# EAGLE board Mk4 Final a (EAGLE 9.0.1), part 3 of 3
## Tracks (layer width: path | path; a pad name or v marks a point on that pad's centre or on a via) (continued)
SDRAM_DQMH  (via drill 0.3) (continued)
  Top 0.15: v33.55,51.75 arc45 33.8,52.35 33.8,59.59 arc-45 34.09,60.29 35.53,61.73 arc-45 36.24,62.02 44.66,62.02 44.77,62.14 arc-90 45.83,62.14 46.09,61.88 55.74,61.88 arc-45 56.09,61.73 56.23,61.59 arc45 56.58,61.45 57.94,61.45 arc-45 58.65,61.15 59.26,60.54 arc-45 59.55,59.84 v59.55,58
  Bottom 0.15: IC2.39 30.99,51.1 arc45 31.69,51.39 31.76,51.46 arc-45 32.46,51.75 v33.55,51.75 | IC1.82 60.4,59.26 arc-45 60.11,58.56 v59.55,58
SDRAM_DQML  (via drill 0.3)
  Top 0.15: v41.05,51.75 41.3,51.75 arc90 42.3,52.75 42.3,56.7 arc90 41.3,57.7 arc-45 40.79,57.91 40.72,57.98 arc-45 40.5,58.51 40.5,59.59 arc-45 40.72,60.12 arc-45 41.34,60.38 arc45 41.64,60.5 41.85,60.71 arc-45 42.55,61 44.63,61 44.77,60.86 arc90 45.83,60.86 45.94,60.98 55.37,60.98 arc-45 55.72,60.83 56.76,59.79 arc-45 57.05,59.09 57.05,59 arc90 58.05,58 v58.8,58
  Bottom 0.15: IC2.15 41.41,51.9 arc45 v41.05,51.75 | IC1.81 60,59.61 arc-45 59.71,58.91 v58.8,58
SIM_CLK  (via drill 0.3)
  Top 0.2: v99.8,39 99.8,38.91 arc45 100.09,38.21 103.01,35.29 arc45 103.71,35 104.64,35 arc-45 105.34,34.71 107.16,32.89 arc45 107.86,32.6 108.7,32.6 108.75,32.55 109.35,32.55 arc-90 109.85,32.05 109.85,31.8 arc-45 109.79,31.66 109.76,31.62 arc45 109.7,31.48 109.7,31.16 arc45 109.85,30.8 v110.45,30.2 | v99.3,55.15 99.3,55.12 99.55,54.87 arc-45 99.7,54.52 99.7,53.2 arc-45 99.59,52.94 arc45 99.3,52.24 v99.3,48
  3V3@2 0.2: v110.45,30.2 110.55,30.1 111.8,30.1 112.55,29.35 112.55,25.7 v114.73,23.52
  Bottom 0.2: J1.C3 v114.73,23.52 | v99.3,48 arc45 99.05,47.4 99.05,41.34 arc-45 98.83,40.81 98.47,40.45 arc45 98.25,39.92 98.25,39.48 arc45 98.4,39.13 98.7,38.83 arc90 99.4,38.83 99.58,39 v99.8,39 | R27.2 99.3,53.72 99.35,53.77 99.35,54.23 99.3,54.28 v99.3,55.15 | IC10.2 110.25,30.4 v110.45,30.2
SIM_CLK_R
  Bottom 0.2: IC5.16 99.2,51.9 R27.1 C49.2
SIM_CTS
  Bottom 0.2: R34.1 86.3,38.25 TP4.TP
SIM_CTS_R
  Bottom 0.15: IC5.4 R34.2
SIM_D_N
  Bottom 0.25: IC5.26 109.15,42.65 109.5,43 109.9,43 arc90 111.6,44.7 111.6,49.37 arc-90 JP9.2
SIM_D_P
  Bottom 0.25: IC5.25 109.15,43.75 109.5,43.4 109.9,43.4 arc90 111.2,44.7 111.2,49.36 arc90 JP9.3
SIM_DATA  (via drill 0.3)
  Top 0.2: v111.55,23.5 113.01,24.96 arc45 113.3,25.66 v113.3,26 | v98.3,48 98.3,51.73 arc-45 98.59,52.44 99.06,52.9 arc45 99.35,53.61 99.35,54.05 arc90 98.85,54.55 98.75,54.55 v98.3,55 | v100.55,38.75 103.51,35.79 arc45 104.21,35.5 104.89,35.5 arc-45 105.59,35.21 107.51,33.29 arc45 108.21,33 108.84,33 arc-45 108.94,32.96 arc45 109.08,32.9 109.7,32.9 arc-90 110.2,32.4 110.2,31.76 arc45 110.35,31.4 v111.1,30.65
  3V3@2 0.2: v113.3,26 113.05,26.25 113.05,29.45 111.85,30.65 v111.1,30.65
  Bottom 0.2: J1.C7 110.67,23.5 v111.55,23.5 | v98.3,48 arc-45 98.55,47.4 98.55,41.33 arc-45 98.33,40.8 98.12,40.59 arc45 97.9,40.06 97.9,39.44 arc45 98.12,38.91 98.59,38.43 arc90 100.01,38.43 100.33,38.75 v100.55,38.75 | R26.2 97.3,53.59 arc-45 97.59,54.29 v98.3,55 | IC10.1 110.5,30.9 arc-45 v111.1,30.65
SIM_DATA_R
  Bottom 0.2: C50.2 R26.1 97.3,51.91 arc45 97.59,51.21 97.81,50.99 arc-45 98.1,50.29 IC5.15
SIM_DCD
  Bottom 0.2: R33.1 87.8,39.25 TP3.TP
SIM_DCD_R
  Bottom 0.15: IC5.5 90.4,39.35 R33.2
SIM_DET
  Bottom 0.2: IC5.14 97,35 arc90 98,34 104.89,34 arc-45 105.59,33.71 106.51,32.79 arc-45 106.8,32.09 R29.2 106.8,28.41 arc45 107.09,27.71 108.45,26.35 arc45 109.15,26.06 J1.C8
SIM_DTR
  Bottom 0.2: R31.1 88.05,41.25 TP2.TP
SIM_DTR_R
  Bottom 0.15: R31.2 R40.1 90.5,40.45 IC5.6
SIM_NETLIGHT
  Bottom 0.15: IC1.108 68.36,54.8 arc45 68.6,54.9 69.02,54.9 69.12,55 71.47,55 arc-90 73.97,52.5 73.97,50.62 arc45 74.12,50.27 74.28,50.11 arc-45 74.42,49.76 74.42,49.5 arc45 74.72,48.79 83.71,39.8 arc-45 84,39.09 84,31.75 arc90 85,30.75 TP12.TP 86.8,31.25 R42.1
SIM_PWR_KEY
  Bottom 0.15: Q1.1 89.22,29 R30.1 TP13.TP 84.7,29 arc-90 83.7,30 83.7,38.97 arc45 83.41,39.68 74.42,48.67 arc-45 74.12,49.38 74.12,49.63 arc45 73.98,49.99 73.82,50.15 arc-45 73.67,50.5 73.67,52.45 arc90 71.42,54.7 69.25,54.7 69.18,54.63 arc-45 69.11,54.6 68.84,54.6 arc45 68.77,54.57 68.63,54.43 arc-45 68.56,54.4 IC1.109
SIM_RI  (via drill 0.3)
  Top 0.15: v66.2,52.8 66.61,52.39 arc45 67.31,52.1 70.57,52.1 arc45 70.96,52.26 arc-45 72.02,52.7 75.66,52.7 arc-45 v75.9,52.6
  Bottom 0.15: 88.52,42.5 88.77,42.25 R32.1 88.8,42.25 TP10.TP 81.96,43.25 76.19,49.01 arc-45 75.9,49.72 v75.9,52.6 | IC1.112 67.01,53.2 arc45 66.31,52.91 v66.2,52.8
SIM_RI_R
  Bottom 0.15: IC5.7 91,41.55 R32.2
SIM_RST  (via drill 0.3)
  Top 0.2: v99.05,39.25 99.05,39.06 arc45 99.27,38.53 103.01,34.79 arc45 103.71,34.5 104.39,34.5 arc-45 105.09,34.21 107.02,32.28 arc45 v107.7,32 | v100.3,54 v100.3,48
  Bottom 0.2: J1.C2 115.8,20.98 115.78,21 113.21,21 arc-45 112.51,21.29 arc-45 112.3,21.79 112.3,23.59 arc45 112.01,24.29 111.84,24.46 arc-45 111.55,25.16 111.55,26.25 arc90 111.05,26.75 110.76,26.75 arc-45 110.4,26.9 107.91,29.39 arc-45 107.7,29.9 | v99.05,39.25 99.05,39.94 arc-45 99.27,40.47 99.33,40.53 arc45 99.55,41.06 99.55,46.84 arc-45 99.84,47.54 v100.3,48 | R28.2 v100.3,54 | 107.7,29.9 v107.7,32 | IC10.4 107.7,29.9
SIM_RST_R
  Bottom 0.2: IC5.17 R28.1 C48.2
SIM_RTS
  Bottom 0.2: TP5.TP R35.1
SIM_RTS_R
  Bottom 0.15: IC5.3 92.35,37.25 R35.2 R39.1
SIM_RXD_R
  Bottom 0.15: IC5.2 91.51,36.05 arc45 90.81,35.76 R37.2 R38.1
SIM_STATUS
  Bottom 0.15: R41.1 86.05,32.25 TP11.TP 84.59,33.71 arc-45 84.3,34.41 84.3,39.22 arc45 84.01,39.93 75.02,48.92 arc-45 74.72,49.62 74.72,49.88 arc45 74.58,50.24 74.42,50.39 arc-45 74.27,50.75 74.27,52.55 arc90 71.52,55.3 69,55.3 68.9,55.2 IC1.107
SIM_STATUS_R
  Bottom 0.15: R41.2 95.85,32.25 IC5.42
SIM_TXD_R
  Bottom 0.15: IC5.1 92,34.95 arc90 91.05,34 arc-90 R36.2
SIM_VBUS
  Bottom 0.25: IC5.24 109.15,44.85 arc90 109.8,45.5 109.8,49.49 JP9.4
SIM_VDD
  Bottom 0.3: C51.2 arc-45 115.3,14.85 115.3,16.84 arc-45 115.59,17.54 116.2,18.15 arc-45 116.9,18.44 J1.C1 117.91,19.2 arc-45 118.2,19.9 118.26,19.96 arc45 118.55,20.66 118.55,21.25 arc90 117.55,22.25 113.8,22.25 arc-90 112.8,23.25 112.8,24.09 arc45 112.51,24.79 112.34,24.96 arc-45 112.05,25.66 112.05,26.75 arc90 111.05,27.75 110.71,27.75 arc-45 110.01,28.04 109.34,28.71 arc-45 109.05,29.41 109.05,30.5 108.65,30.9 IC10.5 108.38,32.59 arc45 108.08,33.29 107.17,34.21 arc45 106.46,34.5 103.71,34.5 arc-45 103.01,34.79 101.59,36.21 arc-45 101.3,36.91 101.3,38.94 arc45 101.08,39.47 100.27,40.28 arc-45 100.05,40.81 100.05,46.34 arc-45 100.34,47.04 101.11,47.81 arc45 101.4,48.51 IC5.18
SOP0  (via drill 0.3)
  Top 0.2: v13.85,28.55 12.91,28.55 arc-45 12.21,28.84 11.34,29.71 arc-45 11.05,30.41 11.05,30.75 arc90 10.05,31.75 9.96,31.75 arc-45 9.26,32.04 8.98,32.32 arc-45 v8.8,32.75
  Bottom 0.2: IC15.35 14.55,27.44 arc45 14.26,28.14 v13.85,28.55 | R64.1 10.05,34.65 9.24,33.84 arc45 8.8,32.78 v8.8,32.75
SOP1  (via drill 0.3)
  Top 0.2: v8.05,32.75 arc45 8.23,32.32 9.51,31.04 arc-45 9.8,30.34 9.8,30 arc90 10.8,29 10.86,29 arc-45 11.56,28.71 12.18,28.09 arc45 12.89,27.8 v13.8,27.8
  Bottom 0.2: IC15.34 14.05,27.34 arc45 13.9,27.7 v13.8,27.8 | R63.1 9,34.7 8.49,34.19 arc45 8.05,33.13 v8.05,32.75
SOP2
  Bottom 0.15: IC15.21 12.22,20.75 arc90 11.97,20.5 11.97,17.43 R62.1
SPK_AMP_N
  Bottom 0.2: IC13.8 19.62,51.17 arc-90 18.62,50.17 16.14,50.17 arc45 15.43,49.88 U5.-
SPK_AMP_P  (via drill 0.3)
  Top 0.2: v22.3,50 18.09,50 arc45 17.59,49.79 arc-45 16.89,49.5 15.3,49.5 arc-90 14.3,50.5 14.3,51.59 arc-45 14.59,52.29 v14.8,52.5
  Bottom 0.2: IC13.5 21.57,51.14 arc45 21.87,50.43 v22.3,50 | U5.+ 13.05,54.66 arc45 13.34,53.96 v14.8,52.5
SPK_N  (via drill 0.3)
  Top 0.2: v48.8,29.9 49.02,29.68 69.01,29.68 arc45 69.72,29.97 75.26,35.51 arc45 75.55,36.21 75.55,45.92 arc-90 76.97,47.34 78.91,47.34 arc45 79.26,47.49 v79.39,47.62 79.56,47.45 v82.4,47.45 | v25.1,58.5 25.07,58.53 arc45 24.36,58.83 15.3,58.83 arc90 13.72,57.25 13.72,49.95 arc90 15.25,48.42 15.52,48.42 arc45 15.87,48.57 v16,48.7
  Bottom 0.2: IC5.12 92.4,47 C68.2 | C65.1 C68.2 | C67.1 C64.2 | C64.2 C68.2 | C64.2 88.97,46.67 84.26,46.67 arc-45 84.19,46.7 84.1,46.8 arc45 84.03,46.83 83.02,46.83 arc-90 v82.4,47.45 | v48.8,29.9 48.57,29.68 48.09,29.68 arc-45 47.38,29.97 45.06,32.28 arc45 44.6,32.48 44.49,32.48 arc-45 43.78,32.77 40.46,36.08 arc45 39.76,36.38 33.19,36.38 arc-45 32.48,36.67 29.67,39.48 arc-45 29.37,40.19 29.37,40.7 arc90 27.7,42.38 25.09,42.38 arc-45 24.38,42.67 22.16,44.88 arc45 21.46,45.17 18.2,45.17 arc-90 17.47,45.9 17.47,47.6 arc90 16.65,48.42 16.48,48.42 arc-45 16.13,48.57 v16,48.7 | 24.25,58.5 C82.2 24.3,58.5 v25.1,58.5 | v79.39,47.62 79.9,47.11 79.9,47.05 80.45,46.5 R43.1
SPK_P  (via drill 0.3)
  Top 0.2: v48.8,29.1 49.02,29.32 69.16,29.32 arc45 69.86,29.62 75.61,35.36 arc45 75.9,36.07 75.9,45.92 arc-90 76.97,46.99 78.96,46.99 arc-45 79.31,46.84 v79.55,46.61 | v25.1,59.45 arc-45 24.44,59.17 15.3,59.17 arc90 13.37,57.25 13.37,49.95 arc90 15.25,48.08 15.52,48.08 arc-45 15.87,47.93 v16,47.8
  Bottom 0.2: IC5.11 90.35,45.95 C68.1 | C68.1 C64.1 | C69.1 C68.1 | C66.1 C64.1 | C64.1 88.97,46.33 84.12,46.33 arc-45 84.05,46.35 83.96,46.45 arc45 83.89,46.48 81.58,46.48 R45.1 80.91,45.86 arc-90 80.2,45.86 79.55,46.51 v79.55,46.61 | v48.8,29.1 48.57,29.32 47.94,29.32 arc-45 47.23,29.62 44.82,32.03 arc45 44.6,32.12 44.34,32.12 arc-45 43.63,32.42 40.32,35.73 arc45 39.61,36.02 33.04,36.02 arc-45 32.33,36.32 29.32,39.34 arc-45 29.02,40.04 29.02,40.7 arc90 27.7,42.02 24.94,42.02 arc-45 24.23,42.32 22.02,44.53 arc45 21.31,44.83 18.2,44.83 arc-90 17.12,45.9 17.12,47.6 arc90 16.65,48.08 16.48,48.08 arc45 16.13,47.93 v16,47.8 | C83.2 v25.1,59.45
SPK_R_N
  Bottom 0.15: R45.2 R46.1 arc45 81.77,50.04 IC11.5
SPK_R_P
  Bottom 0.15: R43.2 R51.1 R50.1 80.83,49.78 arc45 81.12,50.49 IC11.6
SSI0_LCD_CLK
  Bottom 0.15: J2.37 54.05,38.09 arc-45 54.34,38.79 54.71,39.16 arc45 55,39.86 55,41.03 arc45 54.95,41.15 53.91,42.19 arc45 52.67,42.7 52,42.7 arc-90 51,43.7 51,47.1 arc-90 51.5,47.6 IC1.35
SSI0_LCD_CS
  Bottom 0.15: J2.38 53.55,38.09 arc-45 53.84,38.79 54.38,39.33 arc45 54.67,40.04 54.67,40.92 arc45 54.62,41.06 53.71,41.96 arc45 52.65,42.4 51.95,42.4 arc-90 50.7,43.65 50.7,47.25 arc-90 51.45,48 IC1.36
SSI0_LCD_MISO  (via drill 0.3)
  Top 0.15: v53.6,39.8 53.69,39.8 arc45 54.39,40.09 55.01,40.71 arc-45 55.71,41 v56.25,41
  Bottom 0.15: IC1.38 51.35,48.8 arc90 50.1,47.55 50.1,43.55 arc90 51.85,41.8 52.59,41.8 arc-45 53.29,41.51 53.31,41.49 arc-45 53.6,40.79 v53.6,39.8 | J2.33 56.05,40.52 arc-45 v56.25,41
SSI0_LCD_MOSI  (via drill 0.3)
  Top 0.15: v54.15,40.7 arc45 54.75,40.95 55.25,41.45 arc-45 v55.85,41.7
  Bottom 0.15: J2.34 55.55,38.5 55.6,38.55 55.6,41.1 arc-45 v55.85,41.7 | IC1.37 51.4,48.4 arc90 50.4,47.4 50.4,43.6 arc90 51.9,42.1 52.63,42.1 arc-45 53.52,41.73 54,41.25 arc-45 54.15,40.89 v54.15,40.7
SSI2_CC_!CS  (via drill 0.3)
  Top 0.15: v30.8,28 31.5,28 35.66,32.16 arc-45 36.72,32.6 58.49,32.6 arc-45 59.19,32.31 v59.3,32.2 | v65.8,43.2 65.8,43.06 arc-45 65.69,42.8 arc45 65.4,42.1 65.4,35.01 arc-45 65.11,34.31 v64.4,33.6
  Bottom 0.15: IC15.8 17.55,15.95 arc90 18.55,14.95 26.3,14.95 arc90 27.8,16.45 27.8,18.39 arc-45 28.09,19.09 29.51,20.51 arc45 30.1,21.93 30.1,26.94 arc-45 30.39,27.64 30.75,28 v30.8,28 | IC1.3 65.2,44.21 arc45 65.49,43.51 v65.8,43.2 | v64.4,33.6 61.55,33.6 arc-45 61.05,33.81 arc45 60.34,34.1 60.3,34.1 arc90 59.3,33.1 v59.3,32.2
SSI2_CC_CLK  (via drill 0.3)
  Top 0.15: v30.8,30.4 32.63,30.4 35.07,32.84 arc-45 36.66,33.5 56.87,33.5 arc45 58.29,34.09 58.31,34.11 arc-45 59.02,34.4 v61.2,34.4 | v65,43.2 65,41.49 65.02,41.47 65.02,35.44 arc-45 64.73,34.73 v64.4,34.4
  Bottom 0.15: IC15.5 19.05,17.91 arc45 19.34,17.21 20.31,16.24 arc45 21.01,15.95 24.68,15.95 24.7,15.93 26.15,15.93 arc90 26.9,16.68 26.9,18.48 arc-45 27.41,19.71 28.83,21.13 arc45 29.2,22.02 29.2,28.39 arc-45 29.49,29.09 v30.8,30.4 | IC1.4 64.8,43.68 arc45 v65,43.2 | v61.2,34.4 v64.4,34.4
SSI2_CC_MISO  (via drill 0.3)
  Top 0.15: v30.8,28.8 31.88,28.8 35.47,32.39 arc-45 36.7,32.9 60.04,32.9 arc-45 v60.4,32.75 | v66.55,43.24 66.33,43.01 arc-45 66.3,42.96 65.99,42.65 arc45 65.7,41.94 65.7,34.21 arc-45 65.41,33.51 64.7,32.8 v64.4,32.8
  Bottom 0.15: IC15.7 18.05,17 R71.1 18.39,16.75 arc-45 19.09,16.46 19.86,15.69 arc45 20.92,15.25 26.25,15.25 arc90 27.5,16.5 27.5,18.43 arc-45 27.87,19.32 29.29,20.74 arc45 29.8,21.98 29.8,27.39 arc-45 30.09,28.09 v30.8,28.8 | IC1.1 66,44.6 66.11,44.49 arc-45 66.4,43.79 66.4,43.6 arc45 v66.55,43.24 | v64.4,32.8 64.35,32.75 v60.4,32.75
SSI2_CC_MOSI  (via drill 0.3)
  Top 0.15: v30.8,29.6 32.25,29.6 35.27,32.61 arc-45 36.68,33.2 59.69,33.2 arc45 v60.39,33.49 v60.4,33.5 | v65.8,44 66.3,44 arc-90 67.3,43 67.3,35.31 arc-45 67.01,34.61 v64.4,32
  Bottom 0.15: IC15.6 18.55,17.91 arc45 18.84,17.21 20.03,16.02 arc45 20.92,15.65 24.55,15.65 24.58,15.62 26.2,15.62 arc90 27.2,16.62 27.2,18.45 arc-45 27.64,19.51 29.06,20.93 arc45 29.5,22 29.5,27.89 arc-45 29.79,28.59 v30.8,29.6 | IC1.2 65.6,44.48 arc45 v65.8,44 | v60.4,33.5 arc90 59.8,32.9 arc90 60.7,32 v64.4,32
SSI3_CLK
  Bottom 0.15: IC6.6 69.13,42.5 65.15,42.5 arc-90 64.4,43.25 IC1.5
SSI3_DAT0  (via drill 0.3)
  Top 0.15: v62.5,47.2 62.4,47.1 arc45 62.25,46.74 62.25,46.56 arc-45 62.1,46.2 arc45 62,45.95 62,42.41 arc45 62.29,41.71 62.31,41.69 arc-45 62.6,40.99 62.6,40.44 arc-45 v62.5,40.2
  Bottom 0.15: IC1.11 62,45.95 arc-45 62.1,46.2 arc45 62.25,46.56 62.25,46.74 arc-45 62.4,47.1 v62.5,47.2 | IC6.5 65.37,41.24 arc45 64.66,40.95 64.2,40.49 arc-45 63.5,40.2 v62.5,40.2
SSI3_DAT1  (via drill 0.3)
  Top 0.15: v74.1,43.8 68.47,43.8 arc-45 67.77,44.09 66.89,44.97 arc-45 66.6,45.67 66.6,47.09 arc45 66.31,47.79 65.19,48.91 arc45 64.49,49.2 57.81,49.2 arc45 57.11,48.91 55.89,47.69 arc45 55.6,46.99 v55.6,46.6
  Bottom 0.15: IC1.27 v55.6,46.6 | IC6.2 74.11,43.78 v74.1,43.8
SSI3_FSS  (via drill 0.3)
  3V3@2 0.15: v71.4,42.2 71.4,42.7 73.75,45.05 v74.05,45.05
  Bottom 0.15: IC1.6 64,42.9 arc90 65,41.9 70.29,41.9 arc45 70.65,42.05 70.65,42.05 arc-45 71.01,42.2 v71.4,42.2 | v74.05,45.05 IC6.1
SW
  Bottom 0.25: IC9.6 32.9,14.35
  Bottom 0.5: 32.9,14.35 L4.1
SWCLK  (via drill 0.3)
  Top 0.2: J3.4 90.97,64 arc90 89.97,65 84.3,65 arc90 83.3,64 83.3,62.45 arc-90 82.35,61.5 v82.3,61.45
  Bottom 0.2: IC1.100 70.39,58 arc45 71.09,58.29 72.01,59.21 arc-45 72.71,59.5 78.49,59.5 arc45 79.19,59.79 80.56,61.16 arc-45 81.26,61.45 v82.3,61.45 82.39,61.36 JP4.4
SWDIO  (via drill 0.3)
  Top 0.2: J3.2 92.24,64.5 arc90 91.24,65.5 83.3,65.5 arc90 82.3,64.5 v82.3,62.7
  Bottom 0.2: IC1.99 70.29,58.4 arc45 70.99,58.69 71.86,59.56 arc-45 72.56,59.85 78.24,59.85 arc45 78.94,60.14 81.21,62.41 arc-45 81.91,62.7 v82.3,62.7 82.37,62.63 JP4.2
SWO  (via drill 0.3)
  Top 0.2: v81.55,64.25 81.55,61.41 arc45 81.84,60.71 v82.3,60.25
  Bottom 0.2: J3.6 89.7,64.3 arc90 88.7,65.3 82.96,65.3 arc45 82.26,65.01 81.55,64.3 v81.55,64.25 81.55,63.75 78.69,60.89 arc-45 77.99,60.6 72.31,60.6 arc45 71.61,60.31 70.79,59.49 arc-45 70.09,59.2 69.58,59.2 arc-45 69.23,59.35 69.17,59.4 arc45 68.82,59.55 68.78,59.55 arc45 68.43,59.4 68.37,59.35 arc-45 68.02,59.2 IC1.97 | JP4.6 82.46,60.09 v82.3,60.25
T3CCPO_WS2812  (via drill 0.3)
  Top 0.2: v75.6,55.3 76.71,54.19 arc-45 77,53.49 77,51.91 arc-45 76.71,51.21 74.39,48.89 arc-45 73.69,48.6 v70.1,48.6 | v75.6,57.7 69.51,57.7 arc-45 69.37,57.76 69.19,57.94 arc45 69.05,58 68.12,58 arc-45 67.41,58.29 65.8,59.9 arc45 65.44,60.05 65.32,60.05 arc-45 64.62,60.34 61.26,63.7 arc45 61.01,63.8 arc-45 60.31,64.09 59.39,65.01 arc45 58.69,65.3 57.91,65.3 arc-45 57.21,65.59 55.59,67.21 arc45 54.89,67.5 53.16,67.5 arc-90 52.16,68.5 52.16,71 arc90 51.16,72 50.85,72 arc-90 49.85,73 LED1.4
  Bottom 0.2: v75.6,57.7 v75.6,55.3 | v70.1,48.6 69.97,48.47 arc-45 69.62,48.33 69.37,48.33 arc45 69.02,48.18 68.99,48.15 arc-45 68.63,48 IC1.125
T4CCP0  (via drill 0.3)
  Top 0.15: v64.8,47.2 64.52,46.92 arc45 64.38,46.57 arc-45 64.26,46.3 63.99,46.03 arc45 63.7,45.32 63.7,42.61 arc45 63.99,41.91 64.22,41.68 arc-45 64.4,41.24 64.42,41.22 64.42,40.55 arc-45 63.99,39.49 62.97,38.47 arc45 62.6,37.58 62.6,33.72 arc-45 62.23,32.83 60.67,31.27 arc-45 59.78,30.9 59.21,30.9 arc-45 58.51,31.19 58.09,31.61 arc45 57.39,31.9 44.06,31.9 arc45 43.7,31.75 v43.6,31.65 43.54,31.71 arc45 42.84,32 36.87,32 arc45 35.98,31.63 32.47,28.11 arc45 32.1,27.23 32.1,23.41 arc-45 31.81,22.71 29.47,20.37 arc45 29.1,19.48 29.1,18.01 arc-45 28.49,16.54 arc45 28.2,15.84 28.2,15.3 arc-45 27.76,14.24 27.32,13.79 arc45 26.95,12.91 26.95,11.97 arc-45 26.51,10.91 22,6.4 PCB.CH2
  3V3@2 0.15: PCB.CH2 | v10.2,44.2 10.2,43.9 9.8,43.5 9.8,41.5 8.8,40.5 7.3,40.5 6.4,39.6 6.4,38.6 2.17,34.37 JP6.4
  Bottom 0.15: v43.6,31.65 arc-45 43.09,31.86 40.14,34.81 arc45 38.72,35.4 33.03,35.4 arc-45 32.32,35.69 28.73,39.29 arc-45 28.6,39.6 28.6,39.75 arc90 26.85,41.5 23.86,41.5 arc-45 23.16,41.79 21.56,43.39 arc45 20.32,43.9 10.91,43.9 arc-45 v10.21,44.19 v10.2,44.2
  Bottom 0.2: v64.8,47.2 65.23,47.63 arc-90 65.94,47.63 66.23,47.35 arc45 66.58,47.2 IC1.127
T4CCP1  (via drill 0.3)
  Top 0.15: PCB.CH1 28.18,9.9 arc45 27.89,10.61 27.54,10.96 arc-45 27.25,11.66 27.25,12.89 arc-45 27.54,13.59 29.07,15.12 arc45 29.4,15.91 29.4,19.46 arc-45 29.69,20.17 32.03,22.51 arc45 32.4,23.39 32.4,27.21 arc-45 32.69,27.92 36.18,31.41 arc-45 36.89,31.7 42.39,31.7 arc-45 43.09,31.41 43.25,31.25 arc45 43.61,31.1 v44.2,31.1 49.8,31.1 49.85,31.05 57.74,31.05 arc-45 58.44,30.76 arc45 58.82,30.6 59.88,30.6 arc45 60.94,31.04 62.46,32.56 arc45 62.9,33.62 62.9,37.49 arc-45 63.19,38.19 64.21,39.21 arc45 64.72,40.45 64.72,41.34 64.7,41.37 arc45 64.46,41.94 64.29,42.11 arc-45 64,42.81 64,45.19 arc-45 64.29,45.89 v65.6,47.2
  3V3@2 0.15: v9.4,43.9 9.4,41.6 8.8,41 6.8,41 6.05,40.25 6.05,39 3.96,36.91 JP6.5
  Bottom 0.15: v44.2,31.1 43.61,31.1 arc-45 43.25,31.25 39.91,34.59 arc45 38.67,35.1 32.91,35.1 arc-45 32.2,35.39 28.45,39.15 arc-45 28.3,39.5 28.3,39.7 arc90 26.8,41.2 23.82,41.2 arc-45 22.93,41.57 21.34,43.16 arc45 20.28,43.6 10.11,43.6 arc-45 v9.41,43.89 v9.4,43.9
  Bottom 0.2: IC1.128 66.21,46.8 arc-45 65.85,46.95 v65.6,47.2
TCA_!INT  (via drill 0.3)
  Top 0.15: v60.2,46.6 arc-45 59.92,46.02 58.09,44.19 arc90 58.09,41.71 59.65,40.15 arc-45 59.8,39.79 59.8,39.71 arc-45 59.65,39.35 59.45,39.15 arc45 59.3,38.79 59.3,38.35 arc-45 58.86,37.28 58.41,36.84 arc-45 57.35,36.4 54.71,36.4 arc45 54.01,36.11 v53.5,35.6
  Bottom 0.15: R76.1 54.5,27.25 arc-90 53.5,28.25 v53.5,35.6 | IC1.15 60.4,46.19 arc45 60.25,46.55 v60.2,46.6
  Bottom 0.2: IC4.22 75.51,26.25 arc-45 75.15,26.4 74.86,26.69 arc-45 74.85,26.71 arc45 74.7,27.07 74.67,27.1 arc45 74.31,27.25 R76.1
TPS_FB
  Bottom 0.25: IC9.2 R61.1 R60.2 C103.2
UART0_CON_RX  (via drill 0.3)
  Top 0.15: v53.7,47.05 53.7,47.16 53.98,47.44 arc45 54.12,47.79 54.12,47.82 arc-45 54.27,48.17 55.31,49.21 arc-45 56.01,49.5 58.46,49.5 arc45 60.4,50.3 64.71,54.61 arc45 65,55.31 v65,57.5 | v89.3,66.5 v89.29,66.5 88.91,66.12 arc-45 88.56,65.97 88.27,65.97 arc-90 87.77,66.47 JP8.4
  Bottom 0.15: v53.7,47.05 53.65,47.05 53.55,46.95 arc-45 53.19,46.8 IC1.33 | v65,57.5 arc-45 65.27,58.14 67.93,60.81 arc-45 68.64,61.1 76.99,61.1 arc45 77.69,61.39 81.81,65.51 arc-45 82.51,65.8 88.39,65.8 arc45 88.75,65.95 v89.3,66.5
UART0_CON_TX  (via drill 0.3)
  Top 0.15: v53.6,47.8 arc-45 53.74,48.14 55.03,49.43 arc-45 55.92,49.8 58.36,49.8 arc45 60.13,50.53 63.91,54.31 arc45 64.2,55.01 v64.2,57.5 | v88.3,66.5 88.3,72.67 arc-45 88.59,73.38 JP8.5
  Bottom 0.15: v64.2,57.5 67.81,61.11 arc-45 68.51,61.4 76.84,61.4 arc45 77.54,61.69 81.66,65.81 arc-45 82.36,66.1 87.79,66.1 arc45 88.15,66.25 88.3,66.4 v88.3,66.5 | IC1.34 52.79,47.2 arc45 53.15,47.35 v53.6,47.8
UART1_SIM_RX  (via drill 0.3)
  Top 0.15: v68.9,51.4 70.14,51.4 arc45 70.84,51.69 71.18,52.03 arc-45 72.07,52.4 74.46,52.4 arc-45 74.7,52.3 v75.05,51.95
  Bottom 0.15: R36.1 TP9.TP 84.89,35.91 arc-45 84.6,36.61 84.6,39.34 arc45 84.31,40.05 75.32,49.04 arc-45 75.02,49.75 75.02,50.01 arc45 74.88,50.36 74.72,50.52 arc-45 74.58,50.87 74.58,51.01 arc-45 74.72,51.36 74.87,51.51 arc45 v75.05,51.95 | IC1.118 68.3,50.8 v68.9,51.4
UART1_SIM_TX  (via drill 0.3)
  Top 0.15: v68.9,50.6 69.4,51.1 70.34,51.1 arc45 71.04,51.39 71.46,51.81 arc-45 72.16,52.1 73.59,52.1 arc-45 74.29,51.81 v75.1,51
  Bottom 0.15: R37.1 TP8.TP 85.19,37.61 arc-45 84.9,38.31 84.9,39.47 arc45 84.61,40.17 75.62,49.16 arc-45 75.33,49.87 75.33,50.56 arc45 75.18,50.91 75.1,50.99 v75.1,51 | IC1.119 68.7,50.4 v68.9,50.6
UART3_CC_RX  (via drill 0.3)
  Top 0.15: v23.55,19.75 24.26,19.04 arc-45 24.55,18.34 24.55,16.25 arc90 25.55,15.25 25.6,15.25 arc90 26.6,16.25 arc-45 27.04,17.31 27.31,17.58 arc45 27.6,18.29 27.6,19.95 arc-45 28.11,21.18 29.46,22.53 arc45 29.75,23.24 29.75,27.14 arc45 29.46,27.84 28.09,29.21 arc-45 27.8,29.91 27.8,31.63 arc-45 28.09,32.33 JP5.3 28.84,33.04 29.28,32.59 arc45 29.99,32.3 32.74,32.3 arc45 33.62,32.67 34.48,33.52 arc-45 36.6,34.4 56.81,34.4 arc45 57.7,34.77 59.91,36.98 arc45 60.2,37.68 60.2,38.19 arc-45 60.35,38.55 60.55,38.75 arc45 60.7,39.11 60.7,39.98 arc45 60.33,40.87 58.9,42.3 arc-90 58.9,43.71 61.25,46.06 arc45 61.4,46.42 61.4,46.43 arc-45 61.55,46.78 arc45 61.62,46.97 61.62,48.12 arc-45 61.77,48.47 v61.8,48.5
  Bottom 0.15: IC15.55 22.15,23.25 arc-90 23.15,22.25 23.15,20.35 arc45 23.21,20.21 23.27,20.15 arc-45 23.32,20.01 23.32,19.98 v23.55,19.75 R68.1 | IC1.116 62.8,51.6 arc90 61.8,50.6 v61.8,48.5
UART3_CC_TX  (via drill 0.3)
  Top 0.15: v23.55,17.75 24.25,17.05 24.25,16.2 arc90 25.5,14.95 25.65,14.95 arc90 26.9,16.2 arc-45 27.29,17.14 27.53,17.38 arc45 27.9,18.27 27.9,19.62 arc-45 28.56,21.21 29.68,22.33 arc45 30.05,23.22 30.05,31.25 | 30.05,31.25 30.51,31.71 arc-45 31.21,32 32.76,32 arc45 33.82,32.44 34.68,33.3 arc-45 36.62,34.1 56.83,34.1 arc45 57.89,34.54 60.21,36.85 arc45 60.5,37.56 60.5,38.02 arc-45 60.65,38.37 60.85,38.58 arc45 61,38.93 61,45.09 arc-45 61.21,45.59 61.55,45.94 arc45 61.7,46.29 61.7,46.3 arc-45 61.85,46.66 arc45 61.92,46.84 61.92,47.67 arc-45 62.07,48.02 v62.55,48.5 | JP5.2 29.12,31.77 arc-45 29.82,31.48 30.05,31.25
  Bottom 0.15: IC15.57 arc-90 22.45,21.55 22.45,20.06 arc45 22.51,19.92 22.57,19.86 arc-45 22.62,19.72 22.62,19.09 arc45 22.92,18.38 v23.55,17.75 R69.1 | v62.55,48.5 62.55,50.27 arc-90 63.55,51.27 65.42,51.27 65.49,51.2 IC1.117
UART4_EXT_RX  (via drill 0.3)  (3 unrouted)
  Top 0.15: PCB.CH3 15.84,9.1 arc-90 16.84,10.1 24.68,10.1 arc45 25.57,10.47 26.28,11.18 arc45 26.65,12.07 26.65,12.93 arc-45 27.09,13.99 27.53,14.43 arc45 27.9,15.32 27.9,15.86 arc-45 28.27,16.74 arc45 28.8,18.03 28.8,19.55 arc-45 29.24,20.61 31.21,22.58 arc45 31.5,23.29 v31.5,25.5 | v59.2,39.7 59.15,39.65 arc45 59,39.29 59,38.37 arc-45 58.63,37.48 58.22,37.07 arc-45 57.33,36.7 53.41,36.7 arc45 52.71,36.41 51.67,35.37 arc-45 50.78,35 36.56,35 arc45 34.18,34.08 33.6,33.49 arc-45 32.89,33.2 v30.2,33.2
  Top 0.2: J10.1 arc-45 11.9,66.32 11.9,63.51 arc-45 11.61,62.81 10.09,61.29 arc-45 9.39,61 3.55,61 arc90 1.8,59.25 1.8,47.91 arc45 2.09,47.21 3.51,45.79 arc-45 3.8,45.09 v3.8,43 3.8,33.87 arc-45 3.51,33.16 JP6.3
  3V3@2 0.15: 15.8,5.87 PCB.CH3 | v30.2,33.2 30.1,33.2 29.55,33.75 29.55,34.73 28.75,35.53 v28.75,37.35 | v8.5,43 v3.8,43
  Bottom 0.15: v59.2,39.7 59.12,39.78 arc-45 58.98,40.13 58.98,41.37 arc45 58.83,41.72 58.65,41.9 arc-45 58.5,42.26 58.5,43.26 arc-45 58.79,43.97 58.91,44.08 arc45 59.2,44.79 IC1.18 | v30.2,33.2 arc-45 30.71,32.99 31.51,32.19 arc-45 31.8,31.49 31.8,26.21 arc-45 v31.51,25.51 v31.5,25.5 | v8.5,43 20.21,43 arc-45 20.92,42.71 22.51,41.11 arc45 23.75,40.6 26.7,40.6 arc-90 27.7,39.6 27.7,39.03 arc45 27.83,38.73 28.43,38.12 arc-45 v28.75,37.35
  Bottom 0.3: J10.5 J10.1
UART4_EXT_TX  (via drill 0.3)  (3 unrouted)
  Top 0.15: PCB.CH4 12.09,10.11 arc-45 12.8,10.4 24.66,10.4 arc45 25.37,10.69 26.06,11.38 arc45 26.35,12.09 26.35,12.95 arc-45 26.86,14.19 27.31,14.63 arc45 27.6,15.34 27.6,15.88 arc-45 28.04,16.94 arc45 28.5,18.05 28.5,19.57 arc-45 29.01,20.81 30.19,21.99 arc45 30.7,23.23 30.7,25.39 arc-45 v30.99,26.09 v31,26.1 | v58.45,39.7 58.55,39.6 arc-45 58.7,39.24 58.7,38.39 arc-45 58.41,37.68 58.02,37.29 arc-45 57.31,37 53.37,37 arc45 52.48,36.63 51.44,35.59 arc-45 50.74,35.3 36.54,35.3 arc45 33.99,34.3 33.98,34.29 arc-45 33.27,34 v30.2,34
  Top 0.2: J10.2 13.61,67.03 arc-45 13.32,66.32 12.74,65.74 arc45 12.3,64.68 12.3,63.42 arc-45 11.93,62.53 10.37,60.97 arc-45 9.48,60.6 3.7,60.6 arc90 2.2,59.1 2.2,48.06 arc45 2.49,47.36 4.06,45.79 arc-45 4.35,45.09 v4.35,43.8 4.35,32.13 arc-45 4.06,31.42 JP6.2
  3V3@2 0.15: v8.5,43.8 v4.35,43.8 | v29.5,37.35 29.5,35.3 30.2,34.6 v30.2,34
  Bottom 0.15: v58.45,39.7 58.53,39.78 arc45 58.68,40.13 58.68,41.22 arc45 58.53,41.57 58.3,41.8 arc-45 58.15,42.16 58.15,43.34 arc-45 58.44,44.04 58.65,44.25 arc45 58.8,44.61 IC1.19 | v31,26.1 31.21,26.31 arc45 31.5,27.01 31.5,31.29 arc45 31.21,31.99 30.89,32.31 arc45 30.19,32.6 30.1,32.6 arc-90 29.6,33.1 29.6,33.5 arc-90 30.1,34 v30.2,34 | v8.5,43.8 8.71,43.59 arc45 9.41,43.3 20.23,43.3 arc-45 21.12,42.93 22.71,41.34 arc45 23.77,40.9 26.75,40.9 arc-90 28,39.65 28,39.2 arc45 28.16,38.82 29.41,37.56 arc-45 v29.5,37.35
  Bottom 0.3: J10.6 J10.2
USB_D_N
  Bottom 0.2: IC7.1 75.55,73
  Bottom 0.25: 75.55,73 76.06,72.49 arc45 76.76,72.2 77.44,72.2 arc45 78.14,72.49 78.75,73.1 78.95,73.1 | IC1.93 64.8,62.2 arc-90 66.6,64 74.45,64 arc90 75.45,65 75.45,66.85 arc-90 77.3,68.7 79.3,68.7 arc90 80.6,70 80.6,71.75 arc90 79.2,73.15 79,73.15 | U1.D- 69.35,74.25 69.4,74.2 69.4,73.53 arc45 69.69,72.82 69.92,72.59 arc45 70.63,72.3 72.87,72.3 arc45 73.58,72.59 73.79,72.81 arc-45 74.5,73.1 74.8,73.1 74.9,73 IC7.1 | 79,73.15 78.95,73.1 | 79,73.15 arc90 78.95,73.1
USB_D_P
  Bottom 0.2: IC7.2 77.15,73.5 77.3,73.65
  Bottom 0.25: 77.3,73.65 78.9,73.65 79,73.55 79.2,73.55 arc-90 81,71.75 81,70 arc-90 79.3,68.3 77.3,68.3 arc90 75.85,66.85 75.85,65 arc-90 74.45,63.6 66.6,63.6 arc90 65.2,62.2 IC1.94 | U1.D+ 70,74.4 69.8,74.2 69.8,73.69 arc45 70.09,72.99 arc45 70.8,72.7 72.7,72.7 arc45 73.41,72.99 73.62,73.21 arc-45 74.33,73.5 IC7.2
USB_ID
  Bottom 0.15: TP6.TP 78.26,75.54 arc-45 78.55,74.84 R8.2
USB_ID_R  (via drill 0.3)
  Top 0.15: v70.8,73.7 71.81,74.71 arc-45 72.51,75 v75.3,75
  Bottom 0.15: v75.3,75 75.45,75 76.45,74 IC7.4 77.22,74.5 R8.1 | U1.ID 70.65,73.85 v70.8,73.7
USB_SHIELD
  Bottom 0.3: U1.SHIELD@5 73.9,75.91 arc45 74.19,76.61 U1.SHIELD@2 | U1.SHIELD@2 71.64,77.72 U1.SHIELD@1 69.39,77.91 69.21,78.09 U1.SHIELD@0 68.76,78.28 U1.SHIELD@3 66.92,77.57 U1.SHIELD | R7.1 76.42,78.5 C20.2 74.84,78.38 U1.SHIELD@2
V_UNREG  (via drill 0.3)
  Top 0.2: v47.8,15.45 v47.8,15.44 47.88,15.52 47.88,24.6 arc90 46.88,25.6 42.55,25.6 arc-90 41.55,26.6 41.55,28.74 arc45 41.26,29.44 v39.75,30.95
  Top 1.25: 91.42,5.38 91.42,6.05 arc45 90.83,7.47 v86.3,12 v85.05,12
  Top 1.5: PCB.VBATT 91.42,5.38
  3V3@2 1.25: v43.5,15.5 v44.3,15.5 44.35,15.45 v47.8,15.45 72.8,15.45 75.05,13.2 79.35,13.2 80.55,12 v85.05,12 v86.3,12
  Bottom 0.2: 41.3,21.45 IC8.15 41.3,21 | IC8.16 40.8,21 | R18.2 arc90 40.85,31.2 40.35,31.2 arc45 v39.75,30.95
  Bottom 0.4: TP18.TP v44.3,15.5
  pour Bottom (no thermals): 35.3,19 35.3,18 arc90 35.8,17.5 36.8,17.5 arc-90 37.3,17 37.3,15.5 40.8,15.5 41.15,15.15 arc45 41.51,15 44.3,15 arc90 44.8,15.5 arc90 44.3,16 41.92,16 arc-48 41.55,16.17 40.93,16.86 arc-42 40.8,17.19 40.8,17.29 arc-45 40.95,17.65 41.2,17.9 arc45 41.35,18.26 41.35,21.45 41.3,21.5 40.8,21.5 40.5,21.2 40.5,18.45 39.95,17.9 arc-45 39.59,17.75 38.01,17.75 arc-45 37.65,17.9 37.3,18.25 37.3,19
VBAT  (via drill 0.3)
  Bottom 0.15: IC8.14 41.8,21.35 | 42.6,20 C35.1 | IC8.13 42.3,21.35
  Bottom 0.4: TP14.TP 43.44,17.36 arc-45 43.15,18.06 v43.15,18.5
  Bottom 1: J5.2 80.95,16.8 C34.1 | C34.1 79.4,16.65 v79.3,16.75 | C34.1 v80.8,18
  other vias: 42.4,18.5
  pour Bottom (no thermals): 41.8,21.55 41.8,18.2 42,18 43.3,18 43.55,18.3 43.55,18.75 43.05,19.25 43.05,20.9 42.4,21.55
  pour 3V3@2 (no thermals): 80.3,16 43.4,16 42.15,17.25 42.15,18.55 42.4,18.8 43.2,18.8 43.9,18 78.8,18 79.3,18.5 80.8,18.5 81.3,18 81.3,17
VBATT  (via drill 0.3)
  Top 0.15: v30,13 arc45 30.48,12.8 34.1,12.8 v34.3,13
  Top 0.5: LED2.1 69.14,74.29 arc-45 68.44,74 v66.55,74 | LED1.1 53.55,76.1 v53.55,76.25
  3V3@2 0.5: 59.05,76.25 64.3,76.25 v66.55,74
  3V3@2 1: JP2.2 59.8,77 59.05,76.25 v53.55,76.25 35.3,76.25 32.3,73.25 32.3,66 30.8,64.5 v30.8,40.65 v30.8,40.05 | v35.05,13 v34.3,13 34.3,18.41 35,19.11 35,20.55 32.42,23.12 32.42,24.62 33.3,25.5 v33.3,37.3 33.3,37.5 v32.95,37.85
  Bottom 0.25: IC9.1 30.76,13.35 arc45 30.06,13.06 v30,13
  Bottom 0.4: TP15.TP v40.2,13.5
  Bottom 0.5: C1.1 54.42,76.25 v53.55,76.25
  Bottom 1: v30.8,40.65 v30.8,40.05 30.8,40 v32.95,37.85 33.3,37.5 v33.3,37.3
  other vias: 39.55,13.25 38.8,13.25 93.05,22.5 90.55,23.5 92.05,22.5 91.3,22.5
  pour Bottom (no thermals): 39.15,14.4 40.6,14.4 40.6,13.05 arc-90 40.1,12.55 34.45,12.55 34.45,13.5 38.65,13.5 arc90 39.15,14
  pour Bottom (no thermals): 92.89,22.25 91.05,22.25 arc-90 90.05,23.25 90.05,24 arc-90 91.05,25 100.8,25 arc90 101.8,26 101.8,29.25 arc-90 102.8,30.25 103.05,30.25 103.3,30.5 103.3,33 104.8,33 104.8,30.8 arc-90 103.8,29.8 103.55,29.8 arc90 102.55,28.8 102.55,24 arc-90 101.55,23 94.46,23 arc45 93.76,22.71 93.59,22.54 arc-45
  pour 3V3@2 (no thermals): 91.8,25.5 94.3,25.5 95.3,24.5 95.3,23 94.8,22.5 85.3,22.5 83.3,20.5 41.8,20.5 40.6,19.4 40.6,13.6 40.1,13 38.8,13 38.55,13.25 38.55,20.5 40.05,22 81.8,22 84.3,24.5 90.8,24.5
  pour Bottom (no thermals): 32,13.9 32,13.8 32.55,13.8 32.9,13.45 32.9,13.05 arc90 33.4,12.55 34.6,12.55 34.6,13.5 33.95,13.5 33.6,13.85 32.8,13.85 32.75,13.9
VBUS  (via drill 0.3)
  Top 0.2: v77.55,72.95 64.35,72.95 v64.15,72.75
  Top 0.22: v78.3,64.5 78.3,71.79 arc45 78.01,72.49 v77.55,72.95
  3V3@2 0.2: v45.3,28.75 40.55,28.75 v39.3,30
  3V3@2 0.75: 38.8,30 38.8,31.5 42.05,34.75 v42.05,67 v41.55,67.5 | v39.3,30 38.8,30 | 38.8,30 v38.55,30 | v42.05,72.25 63.05,72.25 v63.55,72.75 v64.15,72.75
  Bottom 0.15: v77.55,72.95 77.5,73 IC7.5
  Bottom 0.2: LED6.A v45.3,28.75
  Bottom 0.22: IC1.96 66,61.5 arc-90 67,62.5 77.3,62.5 arc90 78.3,63.5 v78.3,64.5
  Bottom 0.5: TP7.TP v63.55,72.75
  Bottom 0.75: L2.2 v63.55,72.75 | v42.05,67 41.59,67.46 arc-45 41.3,68.16 41.3,71.09 arc-45 41.59,71.79 v42.05,72.25 v42.8,72.25
  pour Bottom (no thermals): 39.85,25.7 39.85,29.95 39.45,30.35 38.45,30.35 38.05,29.95 38.05,25.8 38.65,25.2 39.4,25.2 39.4,25.7
VBUS_L
  Bottom 0.4: U1.VBUS arc-47 L2.1
VDD_ANA  (via drill 0.3)
  Bottom 0.2: IC15.48 22.35,26.95
  Bottom 0.25: C44.1 13.9,29.4 14.76,28.54 arc-45 15.05,27.84 IC15.36 | IC15.25 12.71,22.75 arc-45 12.01,23.04 C62.1 v11.8,24
  Bottom 0.4: 22.35,26.95 arc45 22.83,26.75 C61.1 v24.05,27.5 | C44.1 v13.15,29.75
  Bottom 0.5: C63.1 11.25,33.6 v10.4,33.6 | C63.1 11.3,32.85 v10.4,32.85 | C63.1 L7.1
  pour 3V3@2 (rank 2, no thermals): 24.55,27.75 24.55,27 24.05,26.5 22.3,26.5 21.55,27.5 14.3,27.5 12.3,25.5 12.3,24 11.8,23.5 11.55,23.5 11.3,23.75 11.3,24.5 11.55,24.75 11.55,27.5 11.05,28 10.3,28 9.8,28.5 9.8,32.3 9.5,32.6 9.5,33.5 10,34 10.6,34 11.05,33.55 11.05,30.25 11.3,30 12.8,30 13.05,30.25 15.45,30.25 17.45,28.25 24.05,28.25
VDD_DIG_CC  (via drill 0.3)
  3V3@2 0.5: v16.8,16.25 16.8,17 17.3,17.5 21.3,17.5 22.55,18.75 v23.55,18.75
  3V3@2 1: v23.55,18.75 24.05,18.75 25.1,19.8 25.1,20.6 25.6,21.1 26.97,21.1 27.35,21.48 27.35,25.45 27.3,25.5 v27.3,32.5 v27.3,33.25
  Bottom 0.25: C96.1 v23.55,18.75 23.03,19.27 arc-45 22.97,19.41 22.97,19.86 arc45 22.92,20 22.86,20.06 arc-45 22.8,20.2 22.8,21.75 arc90 21.8,22.75 IC15.56 | IC15.9 17.05,16.85 arc-45 v16.8,16.25 C97.1
  Bottom 0.4: C87.1 26.05,33 25.85,33.2 23.9,33.2 L9.1 | v27.3,33.25 26.4,33.25 C87.1 | v27.3,32.5 26.45,32.5 C87.1
VDD_EXT
  Bottom 0.2: R29.1 105.8,32.5 arc90 104.8,33.5 99.1,33.5 arc90 98.1,32.5 IC5.40
VDD_PA  (via drill 0.3)
  Bottom 0.25: IC15.42 18.05,28 arc-45 18.34,28.71 18.96,29.32 arc45 19.25,30.03 19.25,31.24 arc-45 19.4,31.6 19.67,31.88 C85.1 | IC15.33 13.45,27.05
  Bottom 0.4: C85.1 C84.1 | C84.1 21.57,32.4 v22.05,32.4 | C84.1 21.52,31.4 v22.05,31.4 | C86.1 12.76,29.17 arc-45 13.05,28.46 13.05,27.86 arc45 13.34,27.16 13.45,27.05 | 12.5,29.95 12.5,30.07 | C86.1 12.5,30.07 | 12.5,30.07 v12.5,30.75 | v11.75,30.75 11.75,30.59 arc45 12.04,29.88 C86.1
  pour 3V3@2 (no thermals): 12.8,31.5 12.8,30.5 12.55,30.25 11.55,30.25 11.3,30.5 11.3,32.5 12.8,34 18.3,34 19.3,33 22.05,33 22.55,32.5 22.55,31.5 22.05,31 18.8,31 17.8,32 13.3,32
VDD_PLL
  Bottom 0.25: IC15.24 C94.1
VDD_RAM
  Bottom 0.2: IC15.49 23.14,26.25 arc-45 23.84,25.96 C95.1
VDDC
  Bottom 0.2: 66.6,52 IC1.115 68.4,52 | 62.4,59.8 IC1.87 62.4,61.6
  Bottom 0.25: 66.6,52 65.4,52 arc-90 62.4,55 62.4,59.8 | 62.4,61.6 62.4,61.65 C8.2 | 68.4,52 69.42,52 C6.2 C7.2
WFIF_ANT_L
  Bottom 0.4: L6.2 C77.2 2.1,22.8 ANT1.1
WIFI_ANT
  Bottom 0.35: FL1.OUT 10.25,25.75
  Bottom 0.4: L6.1 C76.2 5.89,23 arc45 6.59,23.29 7.24,23.94 arc45 7.3,24.09 arc-45 7.59,24.79 8.26,25.46 arc-45 8.96,25.75 10.25,25.75
WIFI_ANT_F
  Bottom 0.2: IC15.31 12.45,25.75
  Bottom 0.35: FL1.IN 11.32,25.75
  Bottom 0.4: 12.45,25.75 11.32,25.75
WS2812_OUT
  Top 0.3: LED2.2 67.94,76.29 arc-45 67.24,76 65.21,76 arc-45 64.51,76.29 64.09,76.71 arc45 63.39,77 arc-45 62.92,77.19 JP2.3
WS28212_1
  Top 0.3: LED2.4 63.79,75.96 arc45 63.09,76.25 55.75,76.25 arc-90 54.75,77.25 LED1.2
XOSC0
  Bottom 0.15: IC1.66 54,62.7 C18.2 53.7,63.1 arc90 53.2,63.6 53.15,63.6 arc-90 52.65,64.1 X1.P$1
XOSC1
  Bottom 0.15: IC1.67 54.4,62.7 C19.2 54.7,63.1 arc-90 55.2,63.6 55.25,63.6 arc90 55.75,64.1 X1.P$2

## Text on the board
tPlace: Feigenbaum's (delta) constant | 4. / 6692016091 0299067185 3203820466 2016172581 / 8557747576 8632745651 3430041343 3021131473 / 7138689744 0239480138 1716598485 5189815134 / 4086271420 2793252231 2442988890 8908599449 / 3546323671 3411532481 7142199474 5564436582 / 3793202009 5610583305 7545861765 2222070385 / 4106467494 9428498145 3391726200 5687556659 / 5233987560 3825637225 6480040951 0712838906 / 1184470277 5854285419 8011134401 7500242858 / 5382498335 7155220522 3608725029 1678860362 / 6745272133 9905713160 6875345083 4339344461 / 0370630945 2019115876 9724322735 8983890379 / 4946257251 2890979489 8676833461 1626889116 / 5631234744 6057517953 9122045562 4728070952 / 0219819909 4558581946 1368774456 1739607411 / 5614074243 7544354992 0486918098 2648652368 / 4387027996 4901739779 3425134723 8087371362 / 1160186012 8186102056 3818183540 9759847796 / 4173900328 9361714321 5987824078 9776614391 / 3957640377 6053711909 6932066998 3619842889 / 8183700322 9412030210 6557432955 5038884584 / 9737034727 5321219257 0695841407 4661841981 / 9610061296 4016148771 2944415901 4054679418 / 0019813325 3378592493 3658830704 5999993837 / 5411726563 5530168625 2903221... | OFF | ON
bPlace: GND | VBAT | WS | GND | RX | TX | V | UART0 / Console | HELP? | SCL | SDA | I2C5 | GND | L2 | L1 | RX- | RX+ | TX- | TX+ | 3V3 | V | G | TX | RX | UART4 | !HIB | ON | MIC | OFF | SIM USB | 3V3 | RI | SDA | DTR | I2C5 | SCL | DCD | CTS | CCP1 | RTS | TIM4 | TX | CCP0 | RX | RX | CC UART | STATUS | NETLIGHT | UART4 | TX | PWR_KEY | GND | GND | 3V3 | badge.emfcamp.org/2018 | VBAT | designed and assembled in the UK | T62 | V_UNREG | CC FLASH | VBATT | 0V | I2C5 | 3.3V | UART4 | TX | FET | RX | TIM4 | SDA | CCP0 | Hall | SCL | CCP1 | Wake | OFF | ON | Reset | VBATT